# EasyEDA Pro project 立创·天猛星MSPM0G3507开发板.eprj, board PCB
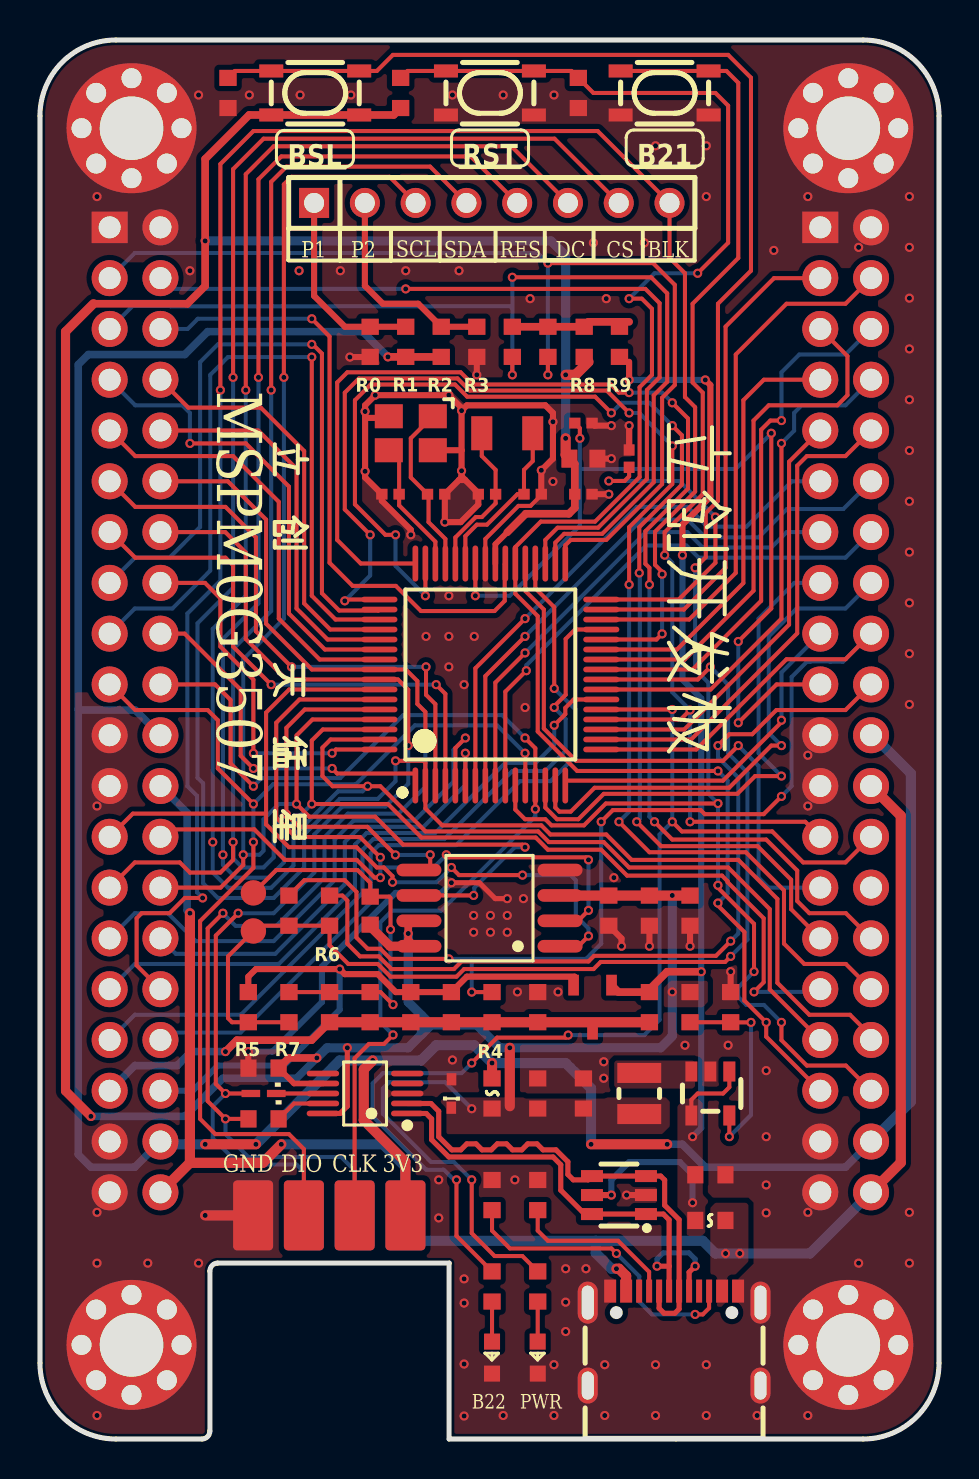
[diagram p3: board, top side]
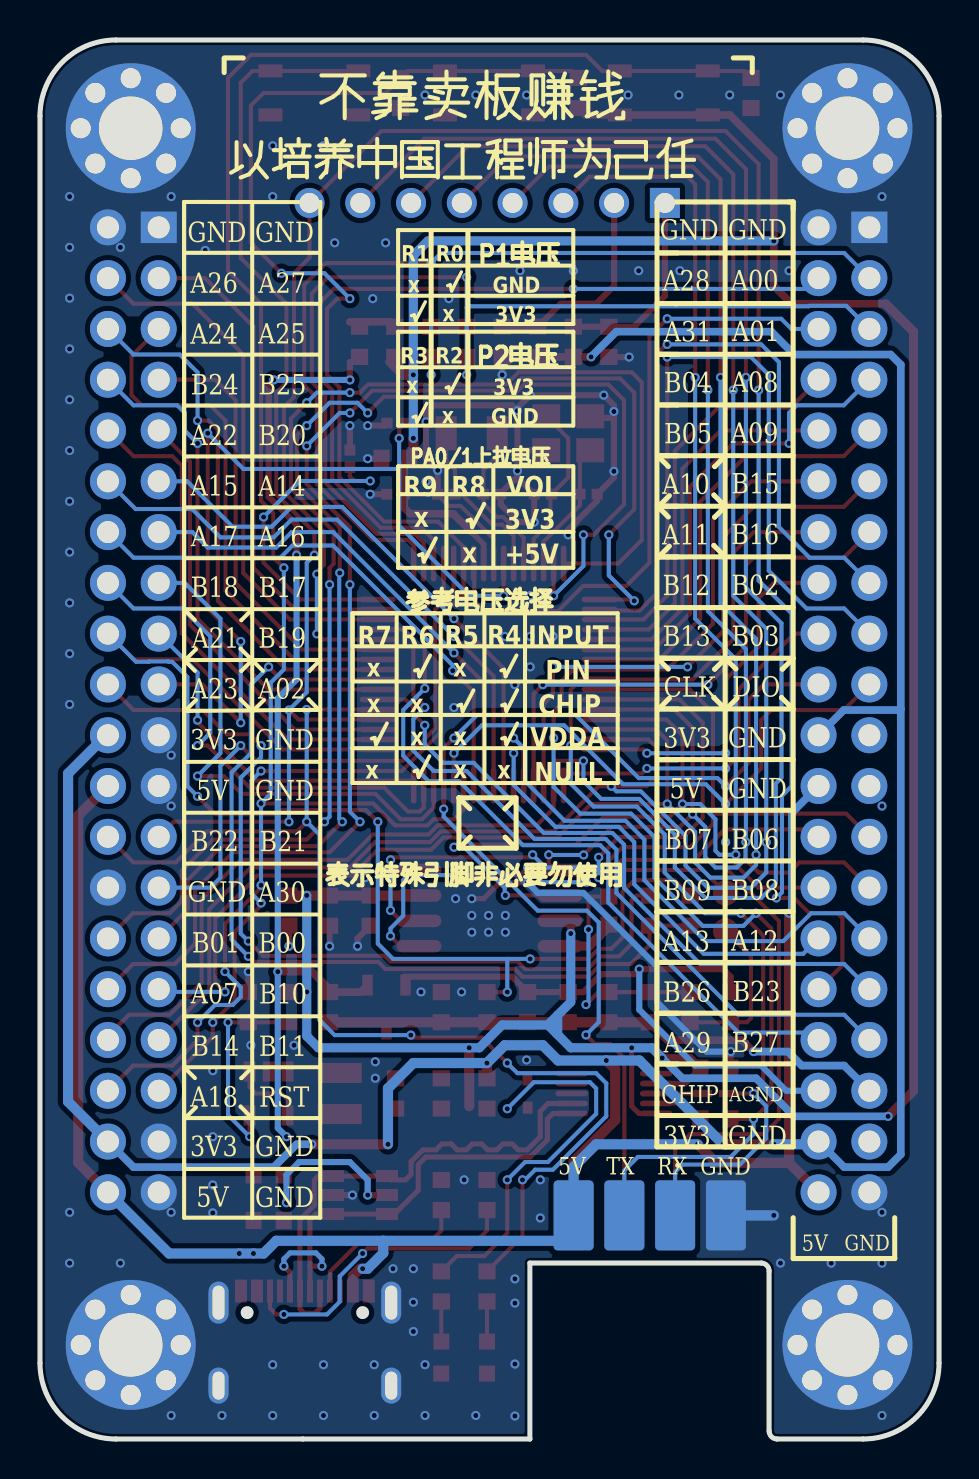
[diagram p4: board, bottom side, seen from below]

Outline 44.97 x 69.97 mm; copper layers: Top Layer, Bottom Layer. Coordinates in mm from the lower left corner of the outline.
Outline path: 0,66.17 arc(1.11,68.85) 3.8,69.97 41.18,69.97 arc(43.86,68.85) 44.97,66.17 44.97,3.8 arc(43.86,1.11) 41.18,0 20.47,0 20.47,8.8 8.9,8.8 arc(8.62,8.68) 8.5,8.4 8.5,0.4 arc(8.38,0.12) 8.1,0 3.8,0 arc(1.11,1.11) 0,3.8 0,66.17
Stack: Top Layer 0.035mm / Dielectric1 1.51mm FR4 er 4.5 / Bottom Layer 0.035mm

## Design rules (mm)
net USB_D-: DP2
net USB_D+: DP2
template: 自定义配置
spacing copperThickness1oz (default): track to track 0.102, other pairs 0.152 to 0.3
spacing copperThickness2oz: track to track 0.203, other pairs 0.152 to 0.3
track width copperThickness1oz (default): min 0.203, default 0.203, max 2.54
track width copperThickness2oz: min 0.203, default 0.305, max 2.54
differential pair differentialPair (default): width min 0.254, default 0.254, max 0.254; gap min 0.102, default 0.102
via viaSize (default): diameter min 0.457, default 0.457, max 10; hole min 0.254, default 0.254, max 6.299
net GND uses copperThickness2oz

## Placement (name value [footprint] x y rotation side)
BSL  null  [KEY-SMD_4P-L4.2-W3.2-P2.20-LS5.1-TL]  13.77 67.32 0 top
C10  null  [R0603]  14.49 21.6 90 top
C11  null  [R0603]  16.52 21.6 90 top
C27  null  [R0603]  33.54 13.22 0 top
C28  null  [R0603]  27.19 17.28 90 top
C29  null  [R0603]  24.9 17.28 90 top
C33  null  [R0603]  26.93 67.32 90 top
C34  null  [R0402]  19.82 47.25 0 top
C35  null  [R0402]  17.53 47.25 0 top
C36  null  [R0402]  24.65 47.25 180 top
C37  null  [R0402]  22.36 47.25 0 top
C38  null  [R0402]  27.19 47.25 180 top
C39  null  [C0603]  27.19 49.03 180 top
C40  null  [R0402]  29.47 49.03 90 top
C44  null  [R0603]  12.45 26.42 270 top
C46  100nF  [R0603]  28.46 26.42 90 top
C47  100nF  [R0603]  11.18 18.55 0 top
C48  null  [R0603]  30.49 21.6 90 top
C49  1uF  [R0603]  18.55 21.6 90 top
C50  100nF  [R0603]  20.58 21.6 90 top
C51  100nF  [R0603]  32.52 26.42 90 top
C52  1uF  [R0603]  30.49 26.42 90 top
D1  BST236A054U  [SOT-23-6_L2.9-W1.6-P0.95-LS2.8-BR]  28.96 12.2 0 top
D6  LESD5Z3.3T1G  [SOD-523F_L1.2-W0.8-LS1.7-RD]  20.58 17.28 90 top
D9  RB521S30T1G  [SOD-523_L1.2-W0.8-LS1.6-RD]  11.18 17.28 180 top
F1  BSMD0603-050-6V  [F0603]  33.54 10.93 180 top
F2  BSMD0603-050-6V  [F0603]  22.61 17.28 90 top
H8  -  [HDR-TH_8P-P2.54-V-M]  22.6 61.82 0 top
hole1  M3  [m3 125x300]  40.44 4.71 0 top
hole2  M3  [m3 125x300]  4.58 4.71 0 top
hole3  M3  [m3 125x300]  4.58 65.55 0 top
hole4  M3  [m3 125x300]  40.44 65.55 0 top
KEY  null  [KEY-SMD_4P-L4.2-W3.2-P2.20-LS5.1-TL]  31.25 67.32 0 top
L1  null  [ind-smd_l2.5-w2.0_tfm252012alma2r2mtaa]  29.98 17.28 90 top
L2  GZ1608D601TF  [L0603]  16.52 26.42 90 top
LINK1  NCD0603G1  [LED0603-RD]  22.61 4.07 90 top
PWR1  NCD0603R1  [LED0603-RD_RED]  24.9 4.07 90 top
R0  0Ω  [R0603]  16.52 54.87 270 top
R1  NC  [R0603]  18.3 54.87 90 top
R2  0Ω  [R0603]  20.07 54.87 270 top
R3  NC  [R0603]  21.85 54.87 90 top
R4  NC  [R0603]  22.61 21.6 270 top
R5  NC  [R0603]  10.42 21.6 90 top
R6  null  [R0603]  14.49 26.42 90 top
R7  NC  [R0603]  12.45 21.6 90 top
R8  null  [R0603]  27.23 54.87 90 top
R9  NC  [R0603]  28.99 54.87 90 top
R14  null  [R0603]  34.55 21.6 90 top
R15  null  [R0603]  32.52 21.6 270 top
R18  null  [R0402]  27.19 50.81 0 top
R19  null  [R0603]  22.61 7.63 270 top
R20  null  [R0603]  23.63 54.87 90 top
R21  null  [R0603]  25.41 54.87 90 top
R24  null  [R0603]  18.04 67.32 270 top
R25  null  [R0603]  9.41 67.32 90 top
R27  null  [R0603]  22.61 12.2 90 top
R28  null  [R0603]  24.9 12.2 90 top
R29  null  [R0603]  24.9 7.63 270 top
R37  200Ω  [R0603]  11.18 16.01 180 top
R42  null  [R0603]  24.9 21.6 90 top
RESET  null  [KEY-SMD_4P-L4.2-W3.2-P2.20-LS5.1-TL]  22.51 67.32 0 top
TP2  -  [Test-Point-1.27mm]  10.68 27.31 180 top
TP4  -  [Test-Point-1.27mm]  10.68 25.41 180 top
U1  -  [LQFP-64_L10.0-W10.0-P0.50-LS12.0-TL]  22.53 38.23 90 top
U9  -  [sot-23-5_l2.9-w1.6-p0.95-ls2.8-bl]  33.54 17.28 180 top
U18  CH340E  [MSOP-10_L3.0-W3.0-P0.50-LS5.0-BL]  16.26 17.28 90 top
U20  2541WV-2x04P  [HDR-TH_8P-P2.54-V-M-R2-C4-S2.54-3]  14.47 11.18 0 top
U21  PZ2.54-2*20  [HDR-TH_40P-P2.54-V-M-R2-C20-S2.54]  4.76 36.47 270 top
U22  PZ2.54-2*20  [HDR-TH_40P-P2.54-V-M-R2-C20-S2.54]  40.31 36.47 270 top
U23  null  [SOT-23-3_L3.0-W1.7-P0.95-LS2.9-BR]  27.64 21.6 90 top
U24  W25Q128JVSIQ  [SOIC-8_L5.3-W5.3-P1.27-LS8.0-BL]  22.49 26.55 90 top
USB1  null  [USB-C-SMD_TYPE-C16PIN]  31.72 5.03 0 top
X1  40MHz  [OSC-SMD_4P-L3.2-W2.5-BL_SIT8008BI]  18.55 50.3 180 top
X3  null  [OSC-SMD_L3.2-W1.5]  23.38 50.3 180 top

## Footprints (pads in the part's own frame, mm; a bottom-side part is the same pattern mirrored in y, then rotated)
C0603
  rect 0.8x0.9 smd: 1(-0.7,0) 2(0.7,0)
F0603
  rect 0.806x0.864 smd: 1(-0.753,0) 2(0.753,0)
HDR-TH_8P-P2.54-V-M
  rect 1.5x1.5 hole 1: 1(-8.89,0)
  round 1.5 hole 1: 2(-6.35,0) 3(-3.81,0) 4(-1.27,0) 5(1.27,0) 6(3.81,0) 7(6.35,0) 8(8.89,0)
HDR-TH_8P-P2.54-V-M-R2-C4-S2.54-3
  rrect 2x3.5 smd far side: 1(3.81,0) 3(1.27,0) 5(-1.27,0) 7(-3.81,0)
  rrect 2x3.5 smd: 2(3.81,0) 4(1.27,0) 6(-1.27,0) 8(-3.81,0)
HDR-TH_40P-P2.54-V-M-R2-C20-S2.54
  rect 1.575x1.8 hole 1.1: 1(-24.13,-1.27)
  round 1.8 hole 1.1: 2(-24.13,1.27) 3(-21.59,-1.27) 4(-21.59,1.27) 5(-19.05,-1.27) 6(-19.05,1.27) 7(-16.51,-1.27) 8(-16.51,1.27) 9(-13.97,-1.27) 10(-13.97,1.27) 11(-11.43,-1.27) 12(-11.43,1.27) 13(-8.89,-1.27) 14(-8.89,1.27) 15(-6.35,-1.27) 16(-6.35,1.27) 17(-3.81,-1.27) 18(-3.81,1.27) 19(-1.27,-1.27) 20(-1.27,1.27) 21(1.27,-1.27) 22(1.27,1.27) 23(3.81,-1.27) 24(3.81,1.27) 25(6.35,-1.27) 26(6.35,1.27) 27(8.89,-1.27) 28(8.89,1.27) 29(11.43,-1.27) 30(11.43,1.27) 31(13.97,-1.27) 32(13.97,1.27) 33(16.51,-1.27) 34(16.51,1.27) 35(19.05,-1.27) 36(19.05,1.27) 37(21.59,-1.27) 38(21.59,1.27) 39(24.13,-1.27) 40(24.13,1.27)
ind-smd_l2.5-w2.0_tfm252012alma2r2mtaa
  rect 1x2.2 smd: 1(1.028,0) 2(-1.028,0)
KEY-SMD_4P-L4.2-W3.2-P2.20-LS5.1-TL
  rect 1.2x0.65 smd: 1(-2.2,1.1) 2(2.2,1.1) 3(-2.2,-1.1) 4(2.2,-1.1)
L0603
  rect 0.8x0.864 smd: 1(-0.7,0) 2(0.7,0)
LED0603-RD
  rect 0.8x0.8 smd: 1(-0.799,0) 2(0.799,0)
LED0603-RD_RED
  rect 0.8x0.8 smd: 1(-0.799,-0.004) 2(0.799,0.004)
LQFP-64_L10.0-W10.0-P0.50-LS12.0-TL
  oval 1.8x0.28 smd: 1(-5.55,3.75) 2(-5.55,3.25) 3(-5.55,2.75) 4(-5.55,2.25) 5(-5.55,1.75) 6(-5.55,1.25) 7(-5.55,0.75) 8(-5.55,0.25) 9(-5.55,-0.25) 10(-5.55,-0.75) 11(-5.55,-1.25) 12(-5.55,-1.75) 13(-5.55,-2.25) 14(-5.55,-2.75) 15(-5.55,-3.25) 16(-5.55,-3.75) 33(5.55,-3.75) 34(5.55,-3.25) 35(5.55,-2.75) 36(5.55,-2.25) 37(5.55,-1.75) 38(5.55,-1.25) 39(5.55,-0.75) 40(5.55,-0.25) 41(5.55,0.25) 42(5.55,0.75) 43(5.55,1.25) 44(5.55,1.75) 45(5.55,2.25) 46(5.55,2.75) 47(5.55,3.25) 48(5.55,3.75)
  oval 0.28x1.8 smd: 17(-3.75,-5.55) 18(-3.25,-5.55) 19(-2.75,-5.55) 20(-2.25,-5.55) 21(-1.75,-5.55) 22(-1.25,-5.55) 23(-0.75,-5.55) 24(-0.25,-5.55) 25(0.25,-5.55) 26(0.75,-5.55) 27(1.25,-5.55) 28(1.75,-5.55) 29(2.25,-5.55) 30(2.75,-5.55) 31(3.25,-5.55) 32(3.75,-5.55) 49(3.75,5.55) 50(3.25,5.55) 51(2.75,5.55) 52(2.25,5.55) 53(1.75,5.55) 54(1.25,5.55) 55(0.75,5.55) 56(0.25,5.55) 57(-0.25,5.55) 58(-0.75,5.55) 59(-1.25,5.55) 60(-1.75,5.55) 61(-2.25,5.55) 62(-2.75,5.55) 63(-3.25,5.55) 64(-3.75,5.55)
m3 125x300
  round 1 hole 1: 1(-2.5,0) 1(-1.768,1.768) 1(-1.768,-1.768) 1(0,2.5) 1(0,-2.5) 1(1.768,1.768) 1(2.5,0)
  round 6.5 hole 3.18x3.175: 1(0,0)
  round 1 hole 1.021x1: 1(1.768,-1.768)
MSOP-10_L3.0-W3.0-P0.50-LS5.0-BL
  oval 0.28x1.62 smd: 1(-1,-2.11) 2(-0.5,-2.11) 3(0,-2.11) 4(0.5,-2.11) 5(1,-2.11) 6(1,2.11) 7(0.5,2.11) 8(0,2.11) 9(-0.5,2.11) 10(-1,2.11)
OSC-SMD_4P-L3.2-W2.5-BL_SIT8008BI
  rect 1.4x1.2 smd: 1(-1.1,-0.85) 2(1.1,-0.85) 3(1.1,0.85) 4(-1.1,0.85)
OSC-SMD_L3.2-W1.5
  rect 1.05x1.7 smd: 1(-1.275,0) 2(1.275,0)
R0402
  rect 0.566x0.54 smd: 1(-0.433,0) 2(0.433,0)
R0603
  rect 0.806x0.864 smd: 1(-0.753,0) 2(0.753,0)
SOD-523_L1.2-W0.8-LS1.6-RD
  rect 0.93x0.36 smd: 1(-0.635,0) 2(0.635,0)
SOD-523F_L1.2-W0.8-LS1.7-RD
  custom 0.609x0.483 smd: 1(-0.711,0.005) 2(0.711,-0.005)
SOIC-8_L5.3-W5.3-P1.27-LS8.0-BL
  oval 0.63x2.25 smd: 1(-1.905,-3.53) 2(-0.635,-3.53) 3(0.635,-3.53) 4(1.905,-3.53) 5(1.905,3.53) 6(0.635,3.53) 7(-0.635,3.53) 8(-1.905,3.53)
SOT-23-3_L3.0-W1.7-P0.95-LS2.9-BR
  rect 1.038x0.532 smd: 1(1.101,-0.95) 2(1.101,0.95) 3(-1.101,0)
sot-23-5_l2.9-w1.6-p0.95-ls2.8-bl
  rect 0.6x1.001 smd: 1(-0.95,-1.1) 2(0,-1.1) 3(0.95,-1.1) 4(0.95,1.1) 5(-0.95,1.1)
SOT-23-6_L2.9-W1.6-P0.95-LS2.8-BR
  rect 1.1x0.6 smd: 1(1.35,-0.95) 2(1.35,0) 3(1.35,0.95) 4(-1.35,0.95) 5(-1.35,0) 6(-1.35,-0.95)
Test-Point-1.27mm
  round 1.27 smd: 1(0,0)
USB-C-SMD_TYPE-C16PIN
  oval 1x2.1 hole 0.6x1.7: 1(-4.32,1.788) 2(4.32,1.788)
  oval 1x1.8 hole 0.6x1.4: 3(-4.32,-2.362) 4(4.32,-2.362)
  rect 0.6x1.15 smd: A1B12(-3.2,2.362) A4B9(-2.4,2.362) B1A12(3.2,2.362) B4A9(2.4,2.362)
  rect 0.3x1.15 smd: A5(-1.25,2.362) A6(-0.25,2.362) A7(0.25,2.362) A8(-1.75,2.362) B5(1.75,2.362) B6(0.75,2.362) B7(-0.75,2.362) B8(1.25,2.362)

## Nets
As in the schematic, except:
3V3: BSL.3 BSL.4 C28.1 C29.1 C38.2 C39.2 C46.2 C47.2 C51.2 C52.2 D6.1 F2.1 L1.2 L2.1 R8.1 R15.1 R24.2 R29.1 U1.40 U18.7 U18.10 U24.3 U24.7 U24.8
AGND: C10.1 C11.1 C48.1 C49.1 C50.1 R4.2 R42.1 U21.35 U23.3
GND: C27.2 C28.2 C29.2 C33.1 C34.2 C35.1 C36.1 C37.1 C38.1 C39.1 C40.2 C46.1 C47.1 C51.1 C52.1 D1.2 D6.2 hole1.1 hole2.1 hole3.1 hole4.1 KEY.3 KEY.4 LINK1.1 PWR1.1 R0.2 R3.1 R14.2 R18.2 R25.1 R27.2 R28.2 R42.2 RESET.3 RESET.4 U1.41 U9.2 U18.3 U20.7 U20.8 U21.1 U21.2 U21.21 U21.23 U21.37 U21.39 U22.1 U22.2 U22.21 U22.23 U22.28 U22.37 U22.39 U24.4 USB1.1 USB1.2 USB1.3 USB1.4 USB1.A1B12 USB1.B1A12 X1.2 X1.4

Pads without a net: U18 4 5 6; USB1 A8 B8

## Via types
v1: diameter 0.457, hole 0.254, Top Layer to Bottom Layer, 287 vias

## Routing (per net, layer and track width the routed paths; a pad name or vN(x,y) marks a point on that pad's centre or on a via; arc(x,y) is an arc through that point)
3V3: length 191.5
  Top Layer w0.203: v1(21.6,12.96) 21.6,10.29 22.74,9.15 24.13,9.15 R29.1
  Top Layer w0.254: v1(15.38,19.57) 15.38,16.64 15.01,16.28 U18.10
  Top Layer w0.28: 23.38,45.35 22.78,44.75 U1.40 ; U18.7 12.71,17.78 C47.2
  Top Layer w0.381: v1(13.85,19.06) 12.45,19.06 C47.2 ; 2.68,56.78 7.37,56.78 8.26,57.67 v1(8.26,59.92) 8.26,64.02 10.47,66.22 BSL.3 17.7,66.22 R24.2 ; 19.52,25.93 18.69,25.93 18.42,25.66 v1(18.42,25.28) 18.42,24.9 ; 23.38,45.35 24.3,46.27 26.46,46.27 26.75,46.56 C38.2 26.75,48.76 C39.2
  Top Layer w0.457: 18.42,24.9 18.66,24.66 ; L2.1 16.52,25.64 17.51,24.65 U24.8 19.52,24.65 ; v1(2.55,16.14) 1.28,17.41 1.28,55.38 2.68,56.78
  Top Layer w0.508: v1(26.3,50.05) 26.3,49.22 C39.2 ; C51.2 C52.2 C46.2 25.57,27.18 25.55,27.2 ; 27.44,53.87 26.79,53.22 v1(26.3,53.22) ; 23.5,16.64 v1(23.5,19.57)
  Bottom Layer w0.203: v1(21.6,16.52) 20.27,17.84 17.46,17.84 17.15,17.53 17.15,16.26 19.57,13.85 20.71,13.85 v1(21.6,12.96)
  Bottom Layer w0.381: v1(13.85,19.06) 12.84,18.04 9.15,18.04 7.25,16.14 v1(2.55,16.14)
  Bottom Layer w0.457: v1(31.63,27.19) v1(31.63,22.36) 31.63,20.15 31.05,19.57 v1(23.5,19.57) 23,19.57 21.85,20.71 19.57,20.71 ; v1(8.26,59.92) 25.57,59.92 26.3,59.19 v1(26.3,53.22) v1(26.3,50.05) ; v1(18.42,25.28) 18.42,21.85 19.08,21.19 ; 19.57,20.71 19.08,21.19 ; 19.57,20.71 19.12,20.26 ; 19.08,21.19 19.08,20.3 19.12,20.26 ; 19.12,20.26 18.42,19.57 v1(15.38,19.57) 14.36,19.57 v1(13.85,19.06)
+5V: length 60.5
  Top Layer w0.203: U9.1 34.49,17.59 34.17,17.28 32.9,17.28 32.59,16.96 U9.4
  Top Layer w0.305: v1(33.28,52.97) 33.54,52.71 33.54,47.12 32.14,45.73 v1(32.14,44.2) ; D1.5 v1(28.58,12.2) ; 29.47,53.87 v1(29.47,52.97)
  Top Layer w0.381: v1(33.08,23.37) 31.37,23.37 30.49,22.49 C48.2 28.94,22.35 U23.1
  Bottom Layer w0.305: v1(32.65,15.12) 33.08,15.55 v1(33.08,23.37) 33.08,37.04 32.14,37.98 v1(32.14,44.2) ; v1(32.65,11.82) 32.65,13.22 32.01,13.85 29.47,13.85 28.58,12.96 v1(28.58,12.2) ; v1(29.47,52.97) v1(33.28,52.97)
AGND: length 28.4
  Top Layer w0.381: C10.1 13.59,19.95 9.85,19.95 v1(9.28,19.38)
  Top Layer w0.508: C10.1 C11.1 C49.1 C50.1 R4.2 R42.1 C48.1
  Bottom Layer w0.381: v1(9.28,19.38) 7.56,19.38 6.87,18.68 4.75,18.68 U21.35
GND: length 75.3
  Top Layer w0.203: U1.41 22.28,45.01 23.94,46.67 24.54,46.67 25.08,47.2 C36.1
  Top Layer w0.254: v1(20.58,27.82) 21.98,27.82 22.78,27.02 v1(23.38,27.02)
  Top Layer w0.305: 21.27,47.96 21.93,47.3 C37.1 21.93,46.74 21.05,45.85 v1(20.25,45.85) C34.2 20.96,47.96 ; 21.27,47.96 20.96,47.96 ; 21.27,47.96 21.09,48.14 ; 16.26,51.07 17.37,51.07 X1.2 ; 16.26,51.07 v1(16.26,51.39) 16.26,51.7 v1(16.77,52.2) v1(20.46,52.2) 21.09,51.57 v1(21.09,51.43) ; 16.26,51.07 v1(16.26,48.4) 16.26,48.09 17.1,47.25 17.1,46.92 18.55,45.47 v1(18.55,45.22) ; v1(29.09,24.65) 29.09,25.03 C46.1 ; 21.09,49.44 v1(21.09,48.42) 21.09,48.14 ; 21.09,49.44 21.08,49.45 X1.4 ; 21.09,49.44 v1(21.09,51.43) ; v1(28.58,50.68) 27.75,50.68 R18.2 ; 21.09,48.14 21.09,48.09 20.96,47.96 ; D1.2 v1(29.35,12.2) ; 25.55,28.47 26.68,28.47 ; C38.1 v1(28.46,47.25) ; v1(21.09,51.43) 21.36,51.7 25.28,51.7 25.66,51.32 v1(25.66,50.87) 25.66,49.03 v1(25.08,48.45) C36.1 ; R0.2 16.51,54.11 v1(15.5,54.11) ; C51.1 v1(32.52,24.65) ; R14.2 v1(34.55,23.38) ; v1(10.42,19.38) 10.42,18.56 C47.1 ; R3.1 v1(21.85,53.22) ; C39.1 v1(28.58,49.03) ; C52.1 v1(30.49,24.65) ; C40.2 v1(29.47,50.68)
  Top Layer w0.508: U20.7 v1(8.26,11.18)
  Bottom Layer w0.305: v1(20.58,27.82) 20.07,27.31 17.79,27.31 14.11,23.63 14.11,21.85 11.63,19.38 v1(10.42,19.38)